# EasyEDA Pro project 效果器12-18.eprj, schematic Schematic5
Create Date: 2024-01-11; Page Name: P1; Project Name: 效果器12-18; Schematic Name: Schematic5; Update Date: 2024-01-11; Company: 嘉立创EDA; Page Size: A4; Version: V1.0
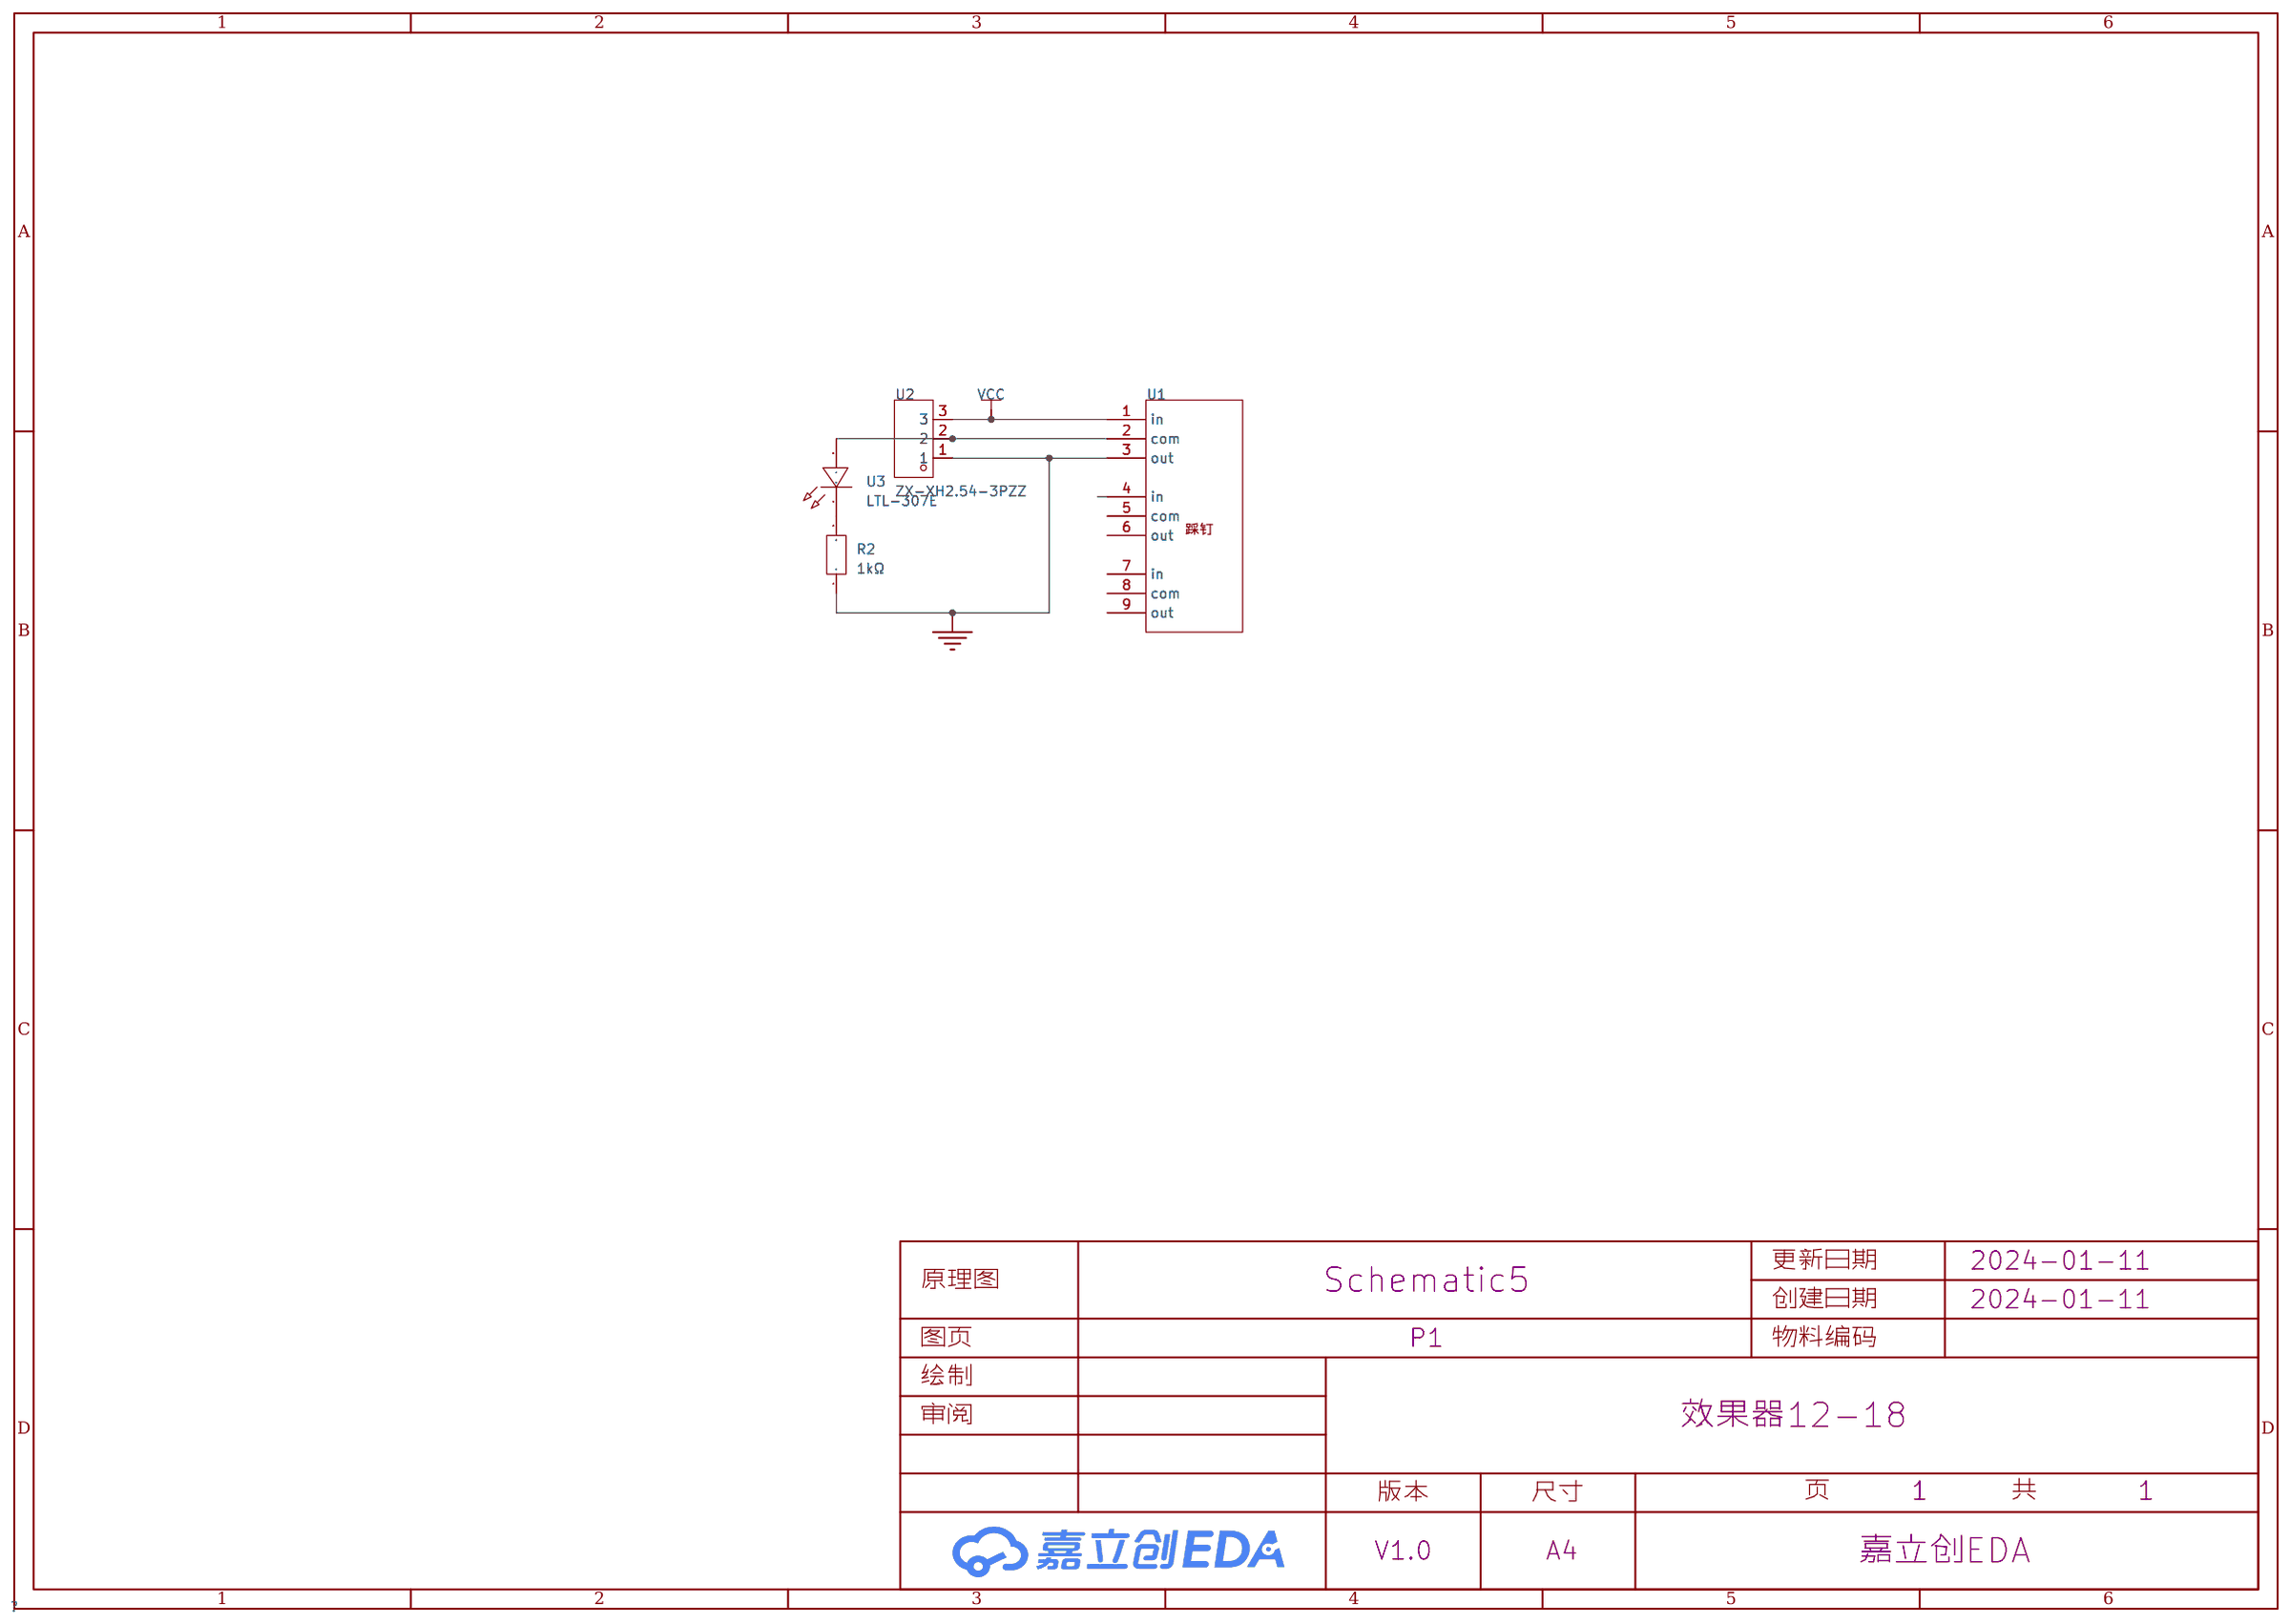
[diagram p7: schematic sheet]

## Parts
R2  1kΩ  [RES-TH_BD2.3-L6.5-P10.50-D0.5]
U1  -  [踩钉封装]
U2  ZX-XH2.54-3PZZ  [CONN-TH_3P-P2.54_2501S-3P]
U3  LTL-307E  [LED-TH_BD5.9-P2.54-RD_RED]

## Library data of the parts
R2 = MF1/4W-1KΩ±1%T52: 电阻类型:金属膜电阻;阻值:1kΩ;精度:±1%;功率:250mW;温度系数:±200ppm/℃;; LCSC Part Name: 1kΩ ±1% 250mW; Supplier Part: C713997; Manufacturer: 华星机电; Supplier Footprint: 轴向引线; JLCPCB Part Class: 扩展库; Datasheet: https://atta.szlcsc.com/upload/public/pdf/source/20200731/C713882_AE8EB1102749D7E4FB4FB13DC898C429.pdf; Supplier: LCSC; Type: 金属膜电阻; Tolerance: ±1%; Power(Watts): 250mW; Temperature Coefficient: ±200ppm/℃
U1 = 踩钉
U2 = ZX-XH2.54-3PZZ: 插针结构:1x3P;间距:2.54mm;安装方式:直插;行距:-;总PIN数:3P;排数:1;每排PIN数:3;参考系列:XH;额定电流:3A;触头材质:黄铜;触头镀层:锡;工作温度范围:-25℃~+85℃;; LCSC Part Name: 1x3P 间距:2.54mm 直插 系列:XH; Supplier Part: C7429633; Manufacturer: Megastar(兆星); Supplier Footprint: 插件,P=2.54mm; JLCPCB Part Class: Extended Part; Datasheet: https://atta.szlcsc.com/upload/public/pdf/source/20230619/AE17037A2CFDBE8D9CBA775D61AD0A84.pdf; Supplier: LCSC; Pins Structure: 1x3P; Pitch: 2.54mm; Mounting Style: 直插; Number of Pins: 3P; Number of Rows: 1; Number of PINs Per Row: 3; Reference Series: XH; Current Rating (Max): 3A; Contact Material: 黄铜; Contact Plating: 锡; Operating Temperature Range: -25℃~+85℃
U3 = LTL-307E: 发光颜色:红灯;透镜颜色:红色;主波长:623nm;发光角度:50°;; LCSC Part Name: 直插F5红光LED; Supplier Part: C575489; Manufacturer: LITEON(光宝); JLCPCB Part Class: 扩展库; Supplier: LCSC; Emitted Color: 红灯; Lens Color: 红色; Dominant Wavelength: 623nm; Peak Wavelength: 635nm; Forward Current: 20mA; Forward Voltage (VF): 2V; Viewing Angle: 50°

## Nets
GND: R2.1 U1.3(out) U2.1
VCC: U1.1(in) U2.3
$1N296: U1.2(com) U2.2 U3.2(A)
$1N557: R2.2 U3.1(C)

Not connected (* = marked no-connect by the designer): U1 4(in) 5(com) 6(out) 7(in) 8(com) 9(out)
